# EAGLE schematic yrl040-1_1 (EAGLE 9.5.0)

## Sheet 1 of 4: Pi, Power, Connectors
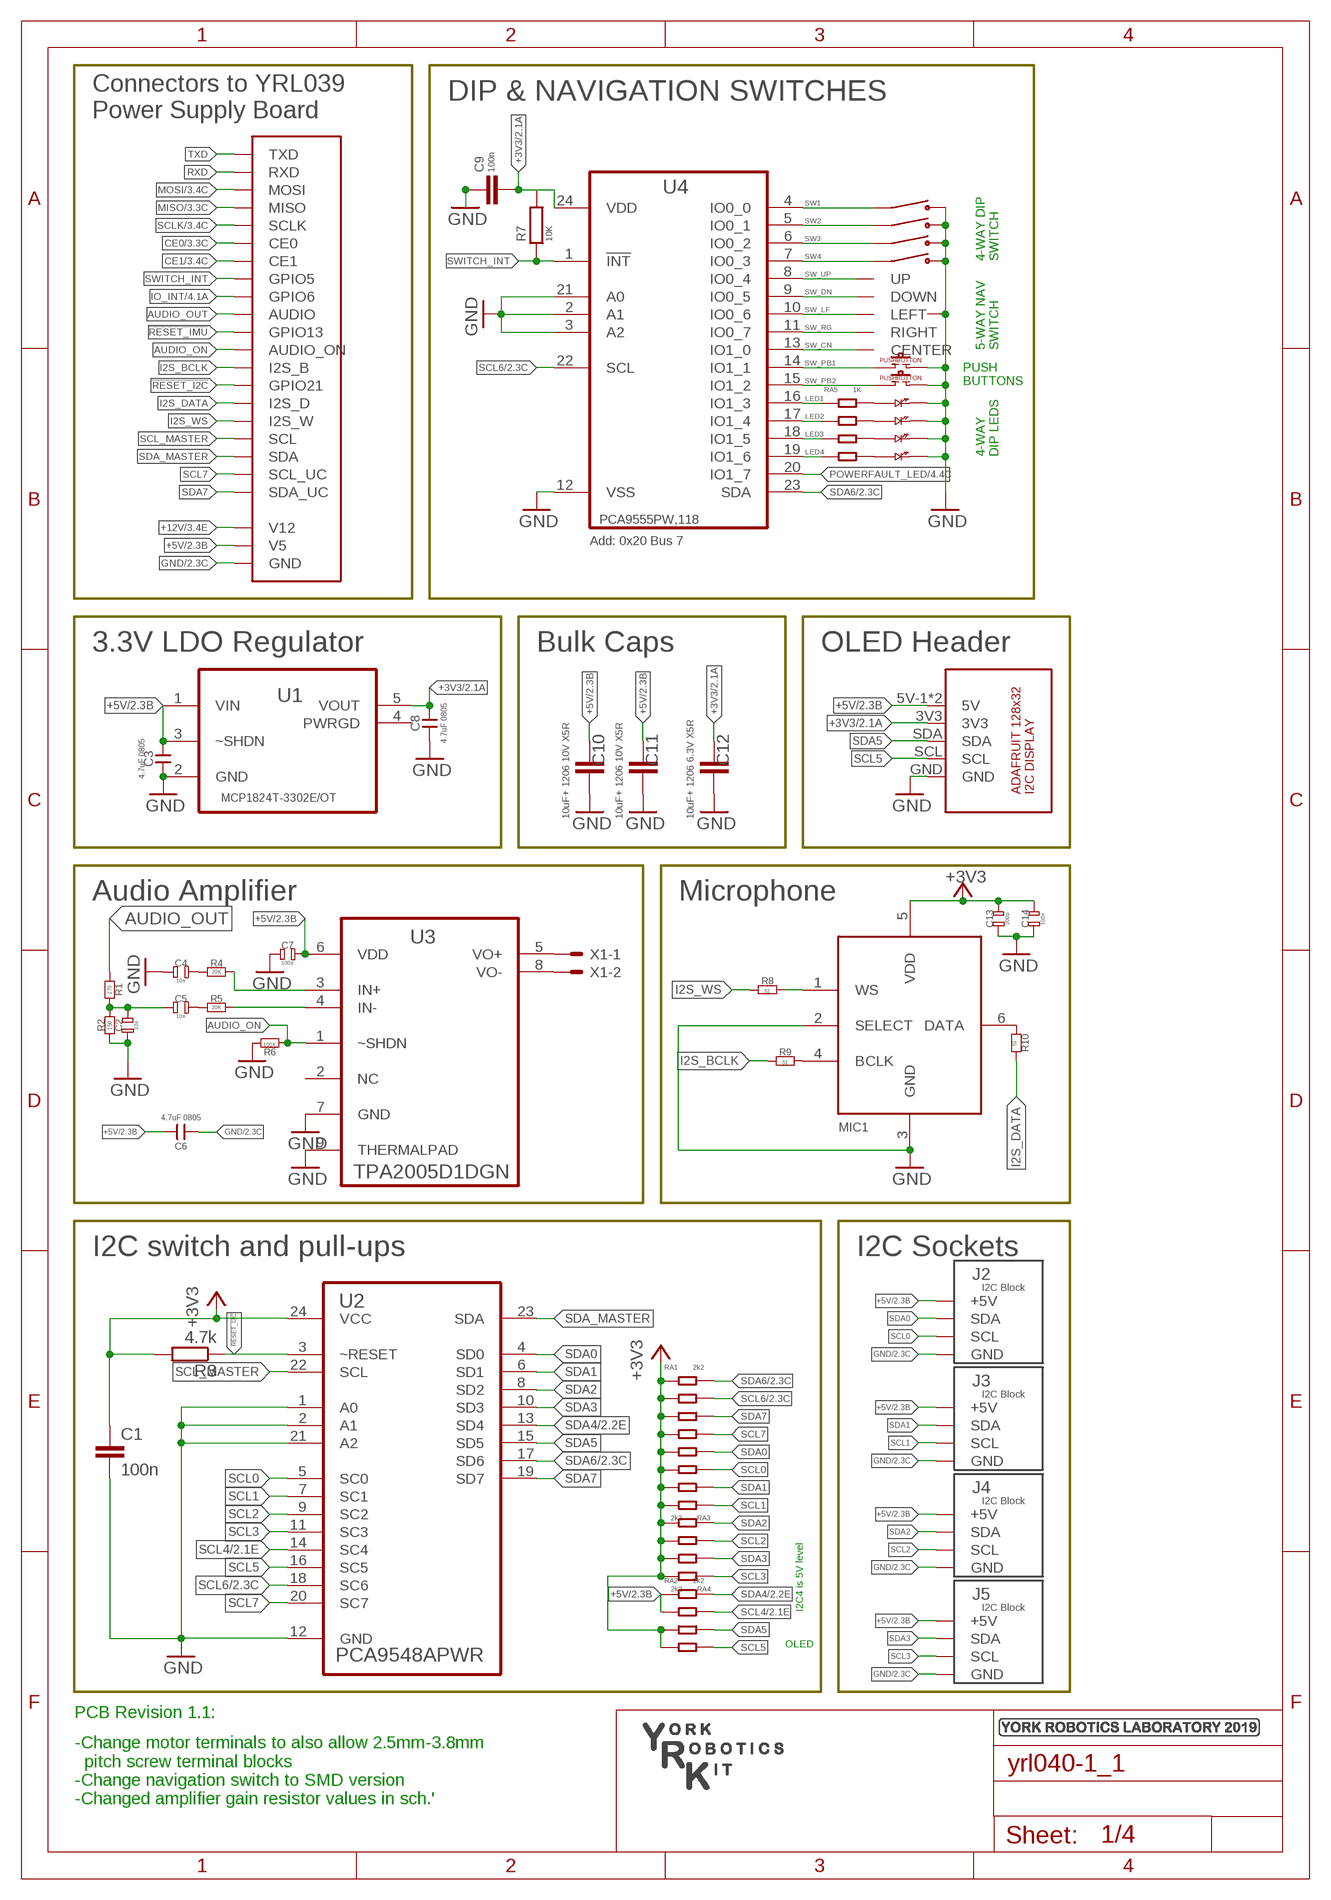
[diagram p0: schematic, sheet 1]

### Parts
C1  100n  C-EUC0603  [C0603]
C2  33n  CAPACITOR-0603  [0603-RESISTOR]
C3  4.7uF 0805  CAPACITOR-0805  [0805]
C4  10n  CAPACITOR-0603  [0603-RESISTOR]
C5  10n  CAPACITOR-0603  [0603-RESISTOR]
C6  4.7uF 0805  CAPACITOR-0805  [0805]
C7  100n  CAPACITOR-0603  [0603-RESISTOR]
C8  4.7uF 0805  CAPACITOR-0805  [0805]
C9  100n  C-EUC0603  [C0603]
C10  10uF+ 1206 10V X5R  C-EUC1206  [C1206]
C11  10uF+ 1206 10V X5R  C-EUC1206  [C1206]
C12  10uF+ 1206 6.3V X5R  C-EUC1206  [C1206]
C13  200p  CAPACITOR-0603  [0603-RESISTOR]
C14  100n  CAPACITOR-0603  [0603-RESISTOR]
J1  CONNECTOR-PAIRS  [CONNECTOR-PAIRS]
J2  I2C-BLOCK-2  [PICOBLADE-4PIN-9733060-2]
J3  I2C-BLOCK-2  [PICOBLADE-4PIN-9733060-2]
J4  I2C-BLOCK-2  [PICOBLADE-4PIN-9733060-2]
J5  I2C-BLOCK-2  [PICOBLADE-4PIN-9733060-2]
J6  YRL012-EXPORTED_ADA-128X32-DISPLAY  [YRL012-EXPORTED_I2C_PI_OLED]
LED1  KPTL-SERIES-REVERSE-MOUNT-LED  [KPTL-SERIES-REVERSE-SMD-LED]
LED2  KPTL-SERIES-REVERSE-MOUNT-LED  [KPTL-SERIES-REVERSE-SMD-LED]
LED3  KPTL-SERIES-REVERSE-MOUNT-LED  [KPTL-SERIES-REVERSE-SMD-LED]
LED4  KPTL-SERIES-REVERSE-MOUNT-LED  [KPTL-SERIES-REVERSE-SMD-LED]
LOGO1  YRL-2019-LOGO  [YRL2019-LOGO]
MIC1  MICROBUILDER_MIC_I2S_SPH0645  [MICROBUILDER_SPH0645LM4H]
R1  270  RESISTOR-0603  [0603-RESISTOR]
R2  150  RESISTOR-0603  [0603-RESISTOR]
R3  4.7k  R-EU_R0603  [R0603]
R4  20K  RESISTOR-0603  [0603-RESISTOR]
R5  20K  RESISTOR-0603  [0603-RESISTOR]
R6  100K  RESISTOR-0603  [0603-RESISTOR]
R7  10K  R-EU_R0603  [R0603]
R8  51  RESISTOR-0603  [0603-RESISTOR]
R9  51  RESISTOR-0603  [0603-RESISTOR]
R10  51  RESISTOR-0603  [0603-RESISTOR]
RA1  2k2  1206-RES-ARRAY-1770134  [1206-RES-ARRAY]
RA2  2k2  1206-RES-ARRAY-1770134  [1206-RES-ARRAY]
RA3  2k2  1206-RES-ARRAY-1770134  [1206-RES-ARRAY]
RA4  2k2  1206-RES-ARRAY-1770134  [1206-RES-ARRAY]
RA5  1K  1206-RES-ARRAY-1770134  [1206-RES-ARRAY]
SCREEN1  YRK-SCREEN-2V11  [SILKSCREEN-V1-1]
SW1  PSISWARM15LIBRARYPSI-SWARM-1-5_01-ROBOT_4-WAY-DIP-1524007-MCEMR-04-T  [PSISWARM15LIBRARYPSI-SWARM-1-5_01-ROBOT_4WAYDIL-MCEMR-04-T]
SW2  PUSH-SWITCH-EVPAS-SERIES  [PCB_SWITCH]
SW3  PUSH-SWITCH-EVPAS-SERIES  [PCB_SWITCH]
SW7  ALPS-SKRHA-SMD-NAV-SWITCH  [ALPS-SKRHA-SERIES-SMD-NAV-SWITCH]
U1  MCP1824T-3302E/OT  [SOT95P270X145-5N]
U2  PCA9548APWR  [SOP65P640X120-24N]
U3  TPA2005D1DGN  [SOP65P488X107-9N]
U4  PCA9555PW,118  [SOP65P640X110-24N]
X1  CON-MOLEX_87758-0216  [CON-MOLEX_87758-0216]

### Nets
!RESET_I2C: J1.GPIO21 R3.1 U2.3(~RESET)
!RESET_IMU: J1.GPIO13 ; also sheet 4
+3V3: C1.1 C8.P$2 C9.2 C12.1 C13.2(SD2) C14.2(SD2) J6.3V3 MIC1.5(VDD) R3.2 R7.2 RA1.P$1 RA1.P$2 RA1.P$3 RA1.P$4 RA2.P$3 RA2.P$4 RA3.P$5 RA3.P$6 RA3.P$7 RA3.P$8 RA4.P$5 RA4.P$6 RA4.P$7 RA4.P$8 U1.5(VOUT) U2.24(VCC) U4.24(VDD) ; also sheet 2,3,4
+5V: C3.P$2 C6.P$2 C7.2(SD2) C10.1 C11.1 J1.V5 J2.V+_1(+5V) J3.V+_1(+5V) J4.V+_1(+5V) J5.V+_1(+5V) J6.5V-1(5V) J6.5V-2(5V) RA2.P$1 RA2.P$2 U1.1(VIN) U1.3(~SHDN) U3.6(VDD) ; also sheet 2,3,4
+12V: J1.V12 ; also sheet 3,4
AUDIO_ON: J1.AUDIO_ON R6.1(SD1) U3.1(~SHDN)
AUDIO_OUT: J1.AUDIO R1.1(SD1)
CE0: J1.CE0 ; also sheet 3
CE1: J1.CE1 ; also sheet 3
GND: C1.2 C2.1(SD1) C3.P$1 C4.1(SD1) C6.P$1 C7.1(SD1) C8.P$1 C9.1 C10.2 C11.2 C12.2 C13.1(SD1) C14.1(SD1) J1.GND1(GND) J1.GND2(GND) J2.GND_1(GND) J3.GND_1(GND) J4.GND_1(GND) J5.GND_1(GND) J6.GND LED1.CATHODE LED2.CATHODE LED3.CATHODE LED4.CATHODE MIC1.2(SELECT) MIC1.3(GND) R2.1(SD1) R6.2(SD2) SW1.5 SW1.6 SW1.7 SW1.8 SW2.P$2 SW3.P$2 SW7.P5-COMMON(COMMON) U1.2(GND) U2.1(A0) U2.2(A1) U2.12(GND) U2.21(A2) U3.7(GND) U3.9(THERMALPAD) U4.2(A1) U4.3(A2) U4.12(VSS) U4.21(A0) ; also sheet 2,3,4
I2S_BCLK: J1.I2S_B R9.1(SD1)
I2S_DATA: J1.I2S_D R10.2(SD2)
I2S_WS: J1.I2S_W R8.1(SD1)
IO_INT: J1.GPIO6 ; also sheet 4
LED1: RA5.P$1 U4.16(IO1_3)
LED2: RA5.P$2 U4.17(IO1_4)
LED3: RA5.P$3 U4.18(IO1_5)
LED4: RA5.P$4 U4.19(IO1_6)
MISO: J1.MISO ; also sheet 3
MOSI: J1.MOSI ; also sheet 3
N$1: LED1.ANODE RA5.P$8
N$2: LED2.ANODE RA5.P$7
N$3: LED3.ANODE RA5.P$6
N$4: LED4.ANODE RA5.P$5
N$5: R4.2(SD2) U3.3(IN+)
N$6: R5.2(SD2) U3.4(IN-)
N$7: C4.2(SD2) R4.1(SD1)
N$8: C5.2(SD2) R5.1(SD1)
N$9: C2.2(SD2) C5.1(SD1) R1.2(SD2) R2.2(SD2)
N$10: U3.5(VO+) X1.1
N$17: U3.8(VO-) X1.2
N$18: MIC1.1(WS) R8.2(SD2)
N$19: MIC1.4(BCLK) R9.2(SD2)
N$33: MIC1.6(DATA) R10.1(SD1)
POWERFAULT_LED: U4.20(IO1_7) ; also sheet 4
RXD: J1.RXD ; also sheet 4
SCL0: J2.SCL_1(SCL) J2.SCL_3(SCL) RA3.P$3 U2.5(SC0)
SCL1: J3.SCL_1(SCL) J3.SCL_3(SCL) RA3.P$1 U2.7(SC1)
SCL2: J4.SCL_1(SCL) J4.SCL_3(SCL) RA4.P$3 U2.9(SC2)
SCL3: J5.SCL_1(SCL) J5.SCL_3(SCL) RA4.P$1 U2.11(SC3)
SCL4: RA2.P$7 U2.14(SC4) ; also sheet 2,3
SCL5: J6.SCL RA2.P$5 U2.16(SC5)
SCL6: RA1.P$7 U2.18(SC6) U4.22(SCL) ; also sheet 2,4
SCL7: J1.SCL_UC RA1.P$5 U2.20(SC7)
SCL_MASTER: J1.SCL U2.22(SCL)
SCLK: J1.SCLK ; also sheet 3
SDA0: J2.SDA_1(SDA) J2.SDA_3(SDA) RA3.P$4 U2.4(SD0)
SDA1: J3.SDA_1(SDA) J3.SDA_3(SDA) RA3.P$2 U2.6(SD1)
SDA2: J4.SDA_1(SDA) J4.SDA_3(SDA) RA4.P$4 U2.8(SD2)
SDA3: J5.SDA_1(SDA) J5.SDA_3(SDA) RA4.P$2 U2.10(SD3)
SDA4: RA2.P$8 U2.13(SD4) ; also sheet 2,3
SDA5: J6.SDA RA2.P$6 U2.15(SD5)
SDA6: RA1.P$8 U2.17(SD6) U4.23(SDA) ; also sheet 2,4
SDA7: J1.SDA_UC RA1.P$6 U2.19(SD7)
SDA_MASTER: J1.SDA U2.23(SDA)
SW1: SW1.1 U4.4(IO0_0)
SW2: SW1.2 U4.5(IO0_1)
SW3: SW1.3 U4.6(IO0_2)
SW4: SW1.4 U4.7(IO0_3)
SW_CN: SW7.P2-CENTER(CENTER) U4.13(IO1_0)
SW_DN: SW7.P6-D[DOWN](DOWN) U4.9(IO0_5)
SW_LF: SW7.P3-C[LEFT](LEFT) U4.10(IO0_6)
SW_PB1: SW2.P$1 U4.14(IO1_1)
SW_PB2: SW3.P$1 U4.15(IO1_2)
SW_RG: SW7.P4-B[RIGHT](RIGHT) U4.11(IO0_7)
SW_UP: SW7.P1-A[UP](UP) U4.8(IO0_4)
SWITCH_INT: J1.GPIO5 R7.1 U4.1(!INT)
TXD: J1.TXD ; also sheet 4
Unconnected: U1.4(PWRGD) U3.2(NC)

### Notes on the sheet
- DIP & NAVIGATION SWITCHES
- Connectors to YRL039 
  Power Supply Board
- 4-WAY DIP
  SWITCH
- 5-WAY NAV
  SWITCH
- PUSH
  BUTTONS
- 4-WAY 
  DIP LEDS
- Add: 0x20 Bus 7
- 3.3V LDO Regulator | Bulk Caps | OLED Header
- Audio Amplifier | Microphone
- I2C switch and pull-ups | I2C Sockets
- I2C4 is 5V level
- OLED
- PCB Revision 1.1:
- -Change motor terminals to also allow 2.5mm-3.8mm
    pitch screw terminal blocks
  -Change navigation switch to SMD version
  -Changed amplifier gain resistor values in sch.'

## Sheet 2 of 4: ADC, Motor Drivers
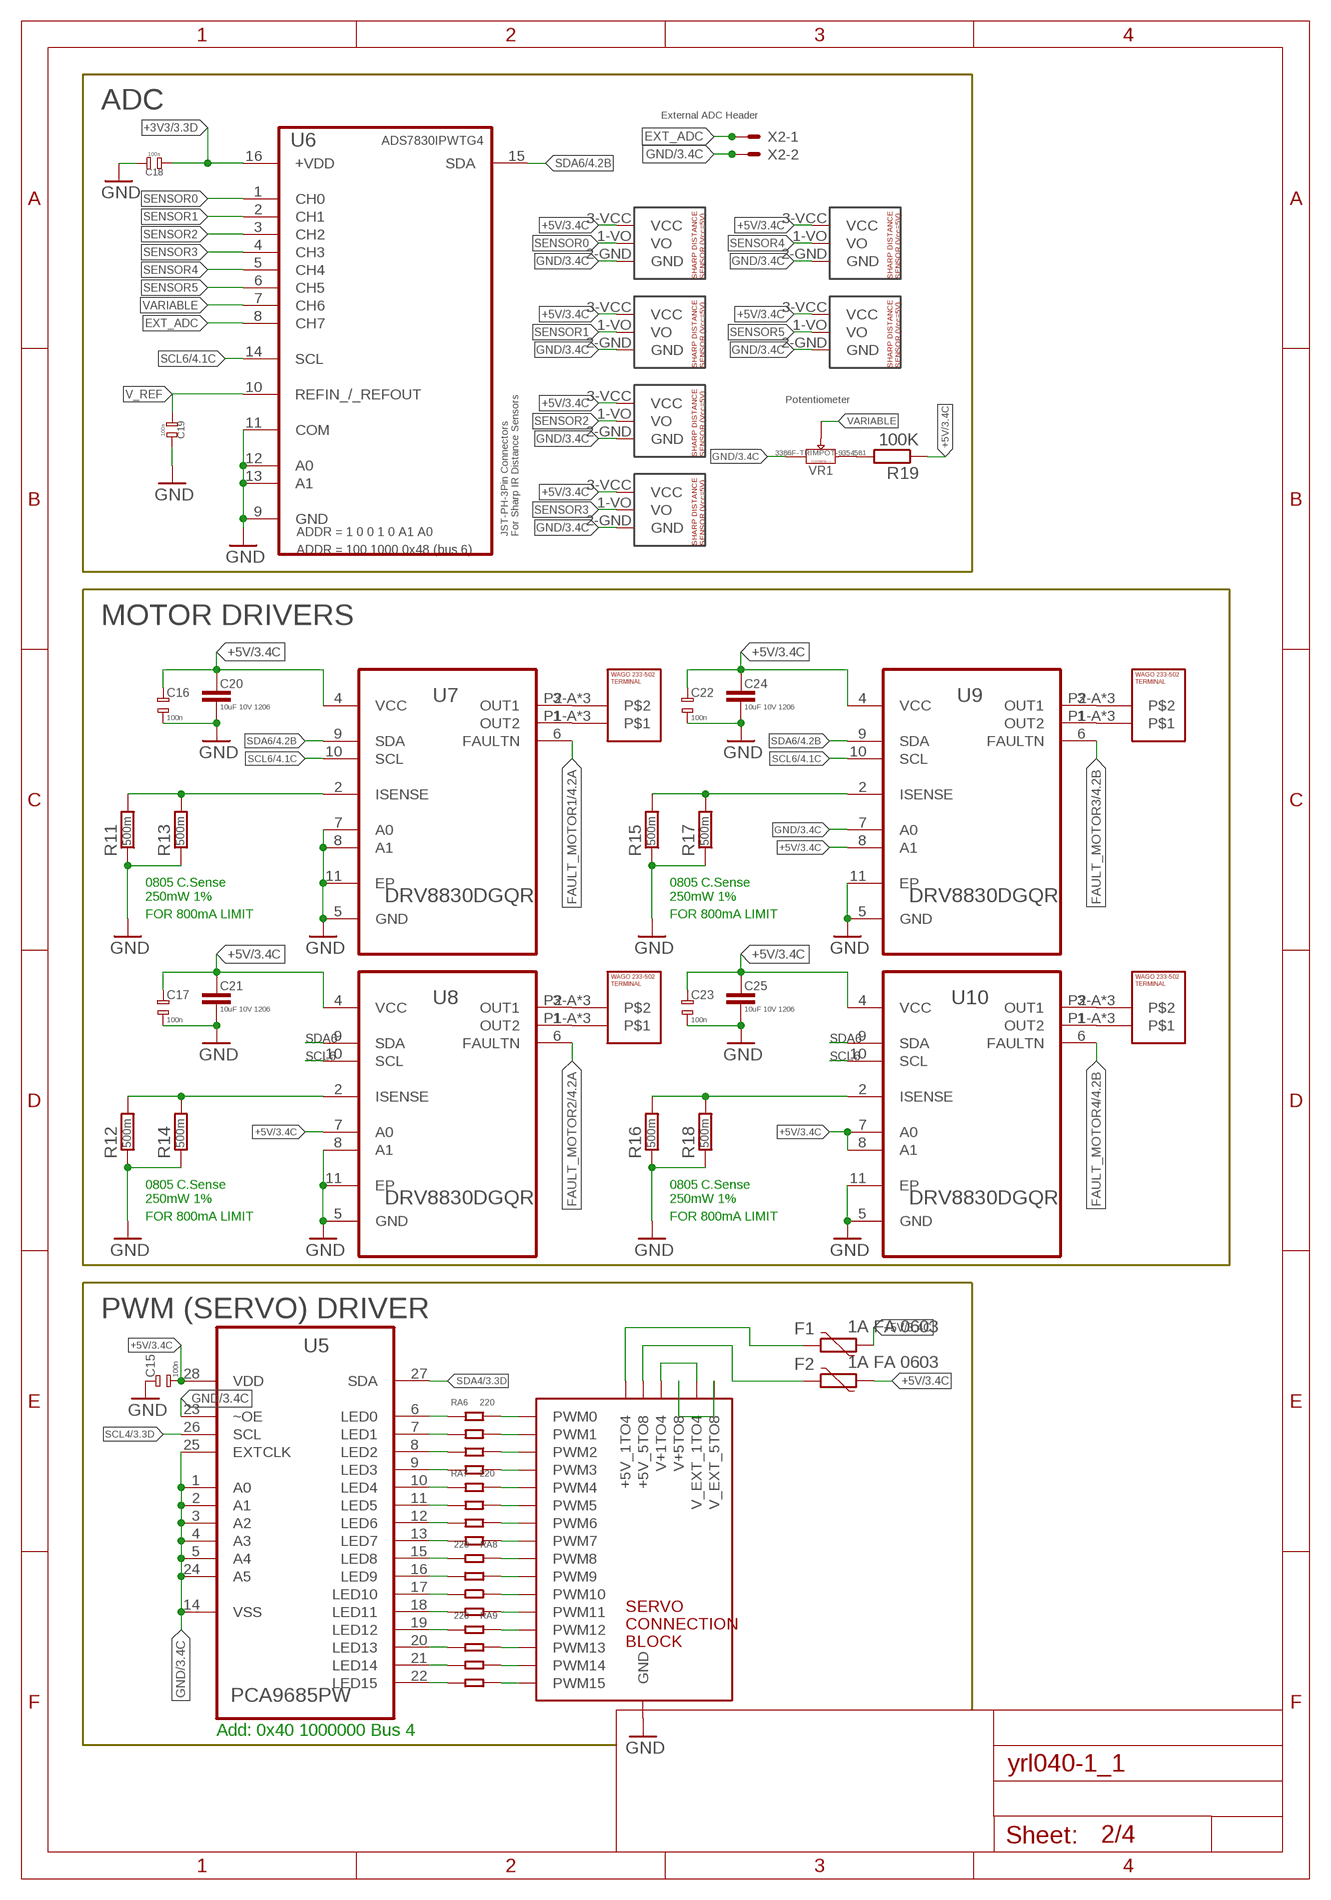
[diagram p1: schematic, sheet 2]

### Parts
C15  100n  CAPACITOR-0603  [0603-RESISTOR]
C16  100n  CAPACITOR-0603  [0603-RESISTOR]
C17  100n  CAPACITOR-0603  [0603-RESISTOR]
C18  100n  CAPACITOR-0603  [0603-RESISTOR]
C19  100n  CAPACITOR-0603  [0603-RESISTOR]
C20  10uF 10V 1206  C-EUC1206  [C1206]
C21  10uF 10V 1206  C-EUC1206  [C1206]
C22  100n  CAPACITOR-0603  [0603-RESISTOR]
C23  100n  CAPACITOR-0603  [0603-RESISTOR]
C24  10uF 10V 1206  C-EUC1206  [C1206]
C25  10uF 10V 1206  C-EUC1206  [C1206]
F1  1A FA 0603  PTC  [0603-1608X90N]
F2  1A FA 0603  PTC  [0603-1608X90N]
J7  SERVO_CONNECTION_BLOCK  [SERVO_BLOCK_8X2]
J8  WAGO-233-502-TERMINAL-DUALMODE  [WAGO-233-502-DUAL]
J9  WAGO-233-502-TERMINAL-DUALMODE  [WAGO-233-502-DUAL]
J10  SHARP-SENSOR  [JST-3PIN-PH]
J11  SHARP-SENSOR  [JST-3PIN-PH]
J12  SHARP-SENSOR  [JST-3PIN-PH]
J13  SHARP-SENSOR  [JST-3PIN-PH]
J14  SHARP-SENSOR  [JST-3PIN-PH]
J15  SHARP-SENSOR  [JST-3PIN-PH]
J16  WAGO-233-502-TERMINAL-DUALMODE  [WAGO-233-502-DUAL]
J17  WAGO-233-502-TERMINAL-DUALMODE  [WAGO-233-502-DUAL]
R11  500m  R-EU_R0805  [R0805]
R12  500m  R-EU_R0805  [R0805]
R13  500m  R-EU_R0805  [R0805]
R14  500m  R-EU_R0805  [R0805]
R15  500m  R-EU_R0805  [R0805]
R16  500m  R-EU_R0805  [R0805]
R17  500m  R-EU_R0805  [R0805]
R18  500m  R-EU_R0805  [R0805]
R19  100K  R-EU_R0603  [R0603]
RA6  220  1206-RES-ARRAY-1770134  [1206-RES-ARRAY]
RA7  220  1206-RES-ARRAY-1770134  [1206-RES-ARRAY]
RA8  220  1206-RES-ARRAY-1770134  [1206-RES-ARRAY]
RA9  220  1206-RES-ARRAY-1770134  [1206-RES-ARRAY]
U5  PCA9685PW  [SOP65P640X110-28N]
U6  ADS7830IPWTG4  [SOP65P640X120-16N]
U7  DRV8830DGQR  [SOP65P640X110-15N]
U8  DRV8830DGQR  [SOP65P640X110-15N]
U9  DRV8830DGQR  [SOP65P640X110-15N]
U10  DRV8830DGQR  [SOP65P640X110-15N]
VR1  3386F-TRIMPOT-9354581  [BOURNS-3386F-TRIMPOT]
X2  CON-MOLEX_87758-0216  [CON-MOLEX_87758-0216]

### Nets
+3V3: C18.1(SD1) U6.16(+VDD) ; also sheet 1,3,4
+5V: C15.2(SD2) C16.1(SD1) C17.1(SD1) C20.1 C21.1 C22.1(SD1) C23.1(SD1) C24.1 C25.1 F1.2 F2.2 J10.3-VCC(VCC) J11.3-VCC(VCC) J12.3-VCC(VCC) J13.3-VCC(VCC) J14.3-VCC(VCC) J15.3-VCC(VCC) R19.1 U5.28(VDD) U7.4(VCC) U8.4(VCC) U8.7(A0) U9.4(VCC) U9.8(A1) U10.4(VCC) U10.7(A0) U10.8(A1) ; also sheet 1,3,4
EXT_ADC: U6.8(CH7) X2.1
FAULT_MOTOR1: U7.6(FAULTN) ; also sheet 4
FAULT_MOTOR2: U8.6(FAULTN) ; also sheet 4
FAULT_MOTOR3: U9.6(FAULTN) ; also sheet 4
FAULT_MOTOR4: U10.6(FAULTN) ; also sheet 4
GND: C15.1(SD1) C16.2(SD2) C17.2(SD2) C18.2(SD2) C19.2(SD2) C20.2 C21.2 C22.2(SD2) C23.2(SD2) C24.2 C25.2 J7.GND1(GND) J7.GND2(GND) J7.GND3(GND) J7.GND4(GND) J7.GND5(GND) J7.GND6(GND) J7.GND7(GND) J7.GND8(GND) J10.2-GND(GND) J11.2-GND(GND) J12.2-GND(GND) J13.2-GND(GND) J14.2-GND(GND) J15.2-GND(GND) R11.1 R12.1 R13.1 R14.1 R15.1 R16.1 R17.1 R18.1 U5.1(A0) U5.2(A1) U5.3(A2) U5.4(A3) U5.5(A4) U5.14(VSS) U5.23(~OE) U5.24(A5) U5.25(EXTCLK) U6.9(GND) U6.11(COM) U6.12(A0) U6.13(A1) U7.5(GND) U7.7(A0) U7.8(A1) U7.11(EP) U8.5(GND) U8.8(A1) U8.11(EP) U9.5(GND) U9.7(A0) U9.11(EP) U10.5(GND) U10.11(EP) VR1.P$1 X2.2 ; also sheet 1,3,4
N$11: R11.2 R13.2 U7.2(ISENSE)
N$12: J8.P1-A J8.P1-B J8.P1-C U7.1(OUT2)
N$13: J8.P2-A J8.P2-B J8.P2-C U7.3(OUT1)
N$14: R12.2 R14.2 U8.2(ISENSE)
N$15: J9.P1-A J9.P1-B J9.P1-C U8.1(OUT2)
N$16: J9.P2-A J9.P2-B J9.P2-C U8.3(OUT1)
N$20: RA6.P$1 U5.6(LED0)
N$21: J7.V+1(V+1TO4) J7.V+2(V+1TO4) J7.V+3(V+1TO4) J7.V+4(V+1TO4) J7.V_EXT(V_EXT_1TO4) J7.V_INT_JUMPER(V+1TO4)
N$22: J7.V+5(V+5TO8) J7.V+6(V+5TO8) J7.V+7(V+5TO8) J7.V+8(V+5TO8) J7.V_EXT1(V_EXT_5TO8) J7.V_INT_JUMPER1(V+5TO8)
N$23: R15.2 R17.2 U9.2(ISENSE)
N$24: J16.P1-A J16.P1-B J16.P1-C U9.1(OUT2)
N$25: J16.P2-A J16.P2-B J16.P2-C U9.3(OUT1)
N$26: R16.2 R18.2 U10.2(ISENSE)
N$27: J17.P1-A J17.P1-B J17.P1-C U10.1(OUT2)
N$28: J17.P2-A J17.P2-B J17.P2-C U10.3(OUT1)
N$29: RA6.P$2 U5.7(LED1)
N$30: RA6.P$3 U5.8(LED2)
N$31: RA6.P$4 U5.9(LED3)
N$32: J7.PWM4(PWM3) RA6.P$5
N$34: J7.PWM3(PWM2) RA6.P$6
N$35: J7.PWM2(PWM1) RA6.P$7
N$36: J7.PWM1(PWM0) RA6.P$8
N$37: RA7.P$1 U5.10(LED4)
N$38: RA7.P$2 U5.11(LED5)
N$39: RA7.P$3 U5.12(LED6)
N$40: RA7.P$4 U5.13(LED7)
N$41: J7.PWM8(PWM7) RA7.P$5
N$42: J7.PWM7(PWM6) RA7.P$6
N$43: J7.PWM6(PWM5) RA7.P$7
N$44: J7.PWM5(PWM4) RA7.P$8
N$45: J7.PWM12(PWM11) RA8.P$4
N$46: J7.PWM11(PWM10) RA8.P$3
N$47: J7.PWM10(PWM9) RA8.P$2
N$48: J7.PWM9(PWM8) RA8.P$1
N$49: RA8.P$8 U5.15(LED8)
N$50: RA8.P$7 U5.16(LED9)
N$51: RA8.P$6 U5.17(LED10)
N$52: RA8.P$5 U5.18(LED11)
N$53: J7.PWM16(PWM15) RA9.P$4
N$54: J7.PWM15(PWM14) RA9.P$3
N$55: J7.PWM14(PWM13) RA9.P$2
N$56: J7.PWM13(PWM12) RA9.P$1
N$57: RA9.P$8 U5.19(LED12)
N$58: RA9.P$7 U5.20(LED13)
N$59: RA9.P$6 U5.21(LED14)
N$60: RA9.P$5 U5.22(LED15)
N$69: F2.1 J7.+5V1(+5V_5TO8)
N$70: F1.1 J7.+5V(+5V_1TO4)
N$91: R19.2 VR1.P$3
SCL4: U5.26(SCL) ; also sheet 1,3
SCL6: U6.14(SCL) U7.10(SCL) U8.10(SCL) U9.10(SCL) U10.10(SCL) ; also sheet 1,4
SDA4: U5.27(SDA) ; also sheet 1,3
SDA6: U6.15(SDA) U7.9(SDA) U8.9(SDA) U9.9(SDA) U10.9(SDA) ; also sheet 1,4
SENSOR0: J10.1-VO(VO) U6.1(CH0)
SENSOR1: J11.1-VO(VO) U6.2(CH1)
SENSOR2: J12.1-VO(VO) U6.3(CH2)
SENSOR3: J13.1-VO(VO) U6.4(CH3)
SENSOR4: J14.1-VO(VO) U6.5(CH4)
SENSOR5: J15.1-VO(VO) U6.6(CH5)
V_REF: C19.1(SD1) U6.10(REFIN_/_REFOUT)
VARIABLE: U6.7(CH6) VR1.P$2

### Notes on the sheet
- ADC
- External ADC Header
- Potentiometer
- ADDR = 1 0 0 1 0 A1 A0
- JST-PH-3Pin Connectors
  For Sharp IR Distance Sensors
- ADDR = 100 1000 0x48 (bus 6)
- MOTOR DRIVERS
- 0805 C.Sense
  250mW 1%
- 0805 C.Sense
  250mW 1%
- FOR 800mA LIMIT | FOR 800mA LIMIT
- 0805 C.Sense
  250mW 1%
- 0805 C.Sense
  250mW 1%
- FOR 800mA LIMIT | FOR 800mA LIMIT
- PWM (SERVO) DRIVER
- Add: 0x40 1000000 Bus 4

## Sheet 3 of 4: Arduino